# EasyEDA Pro project ProPrj_Avaota A1 八核 AIoT 开发板_2024-05-03.epro, board 点位_BOTTOM (continued)
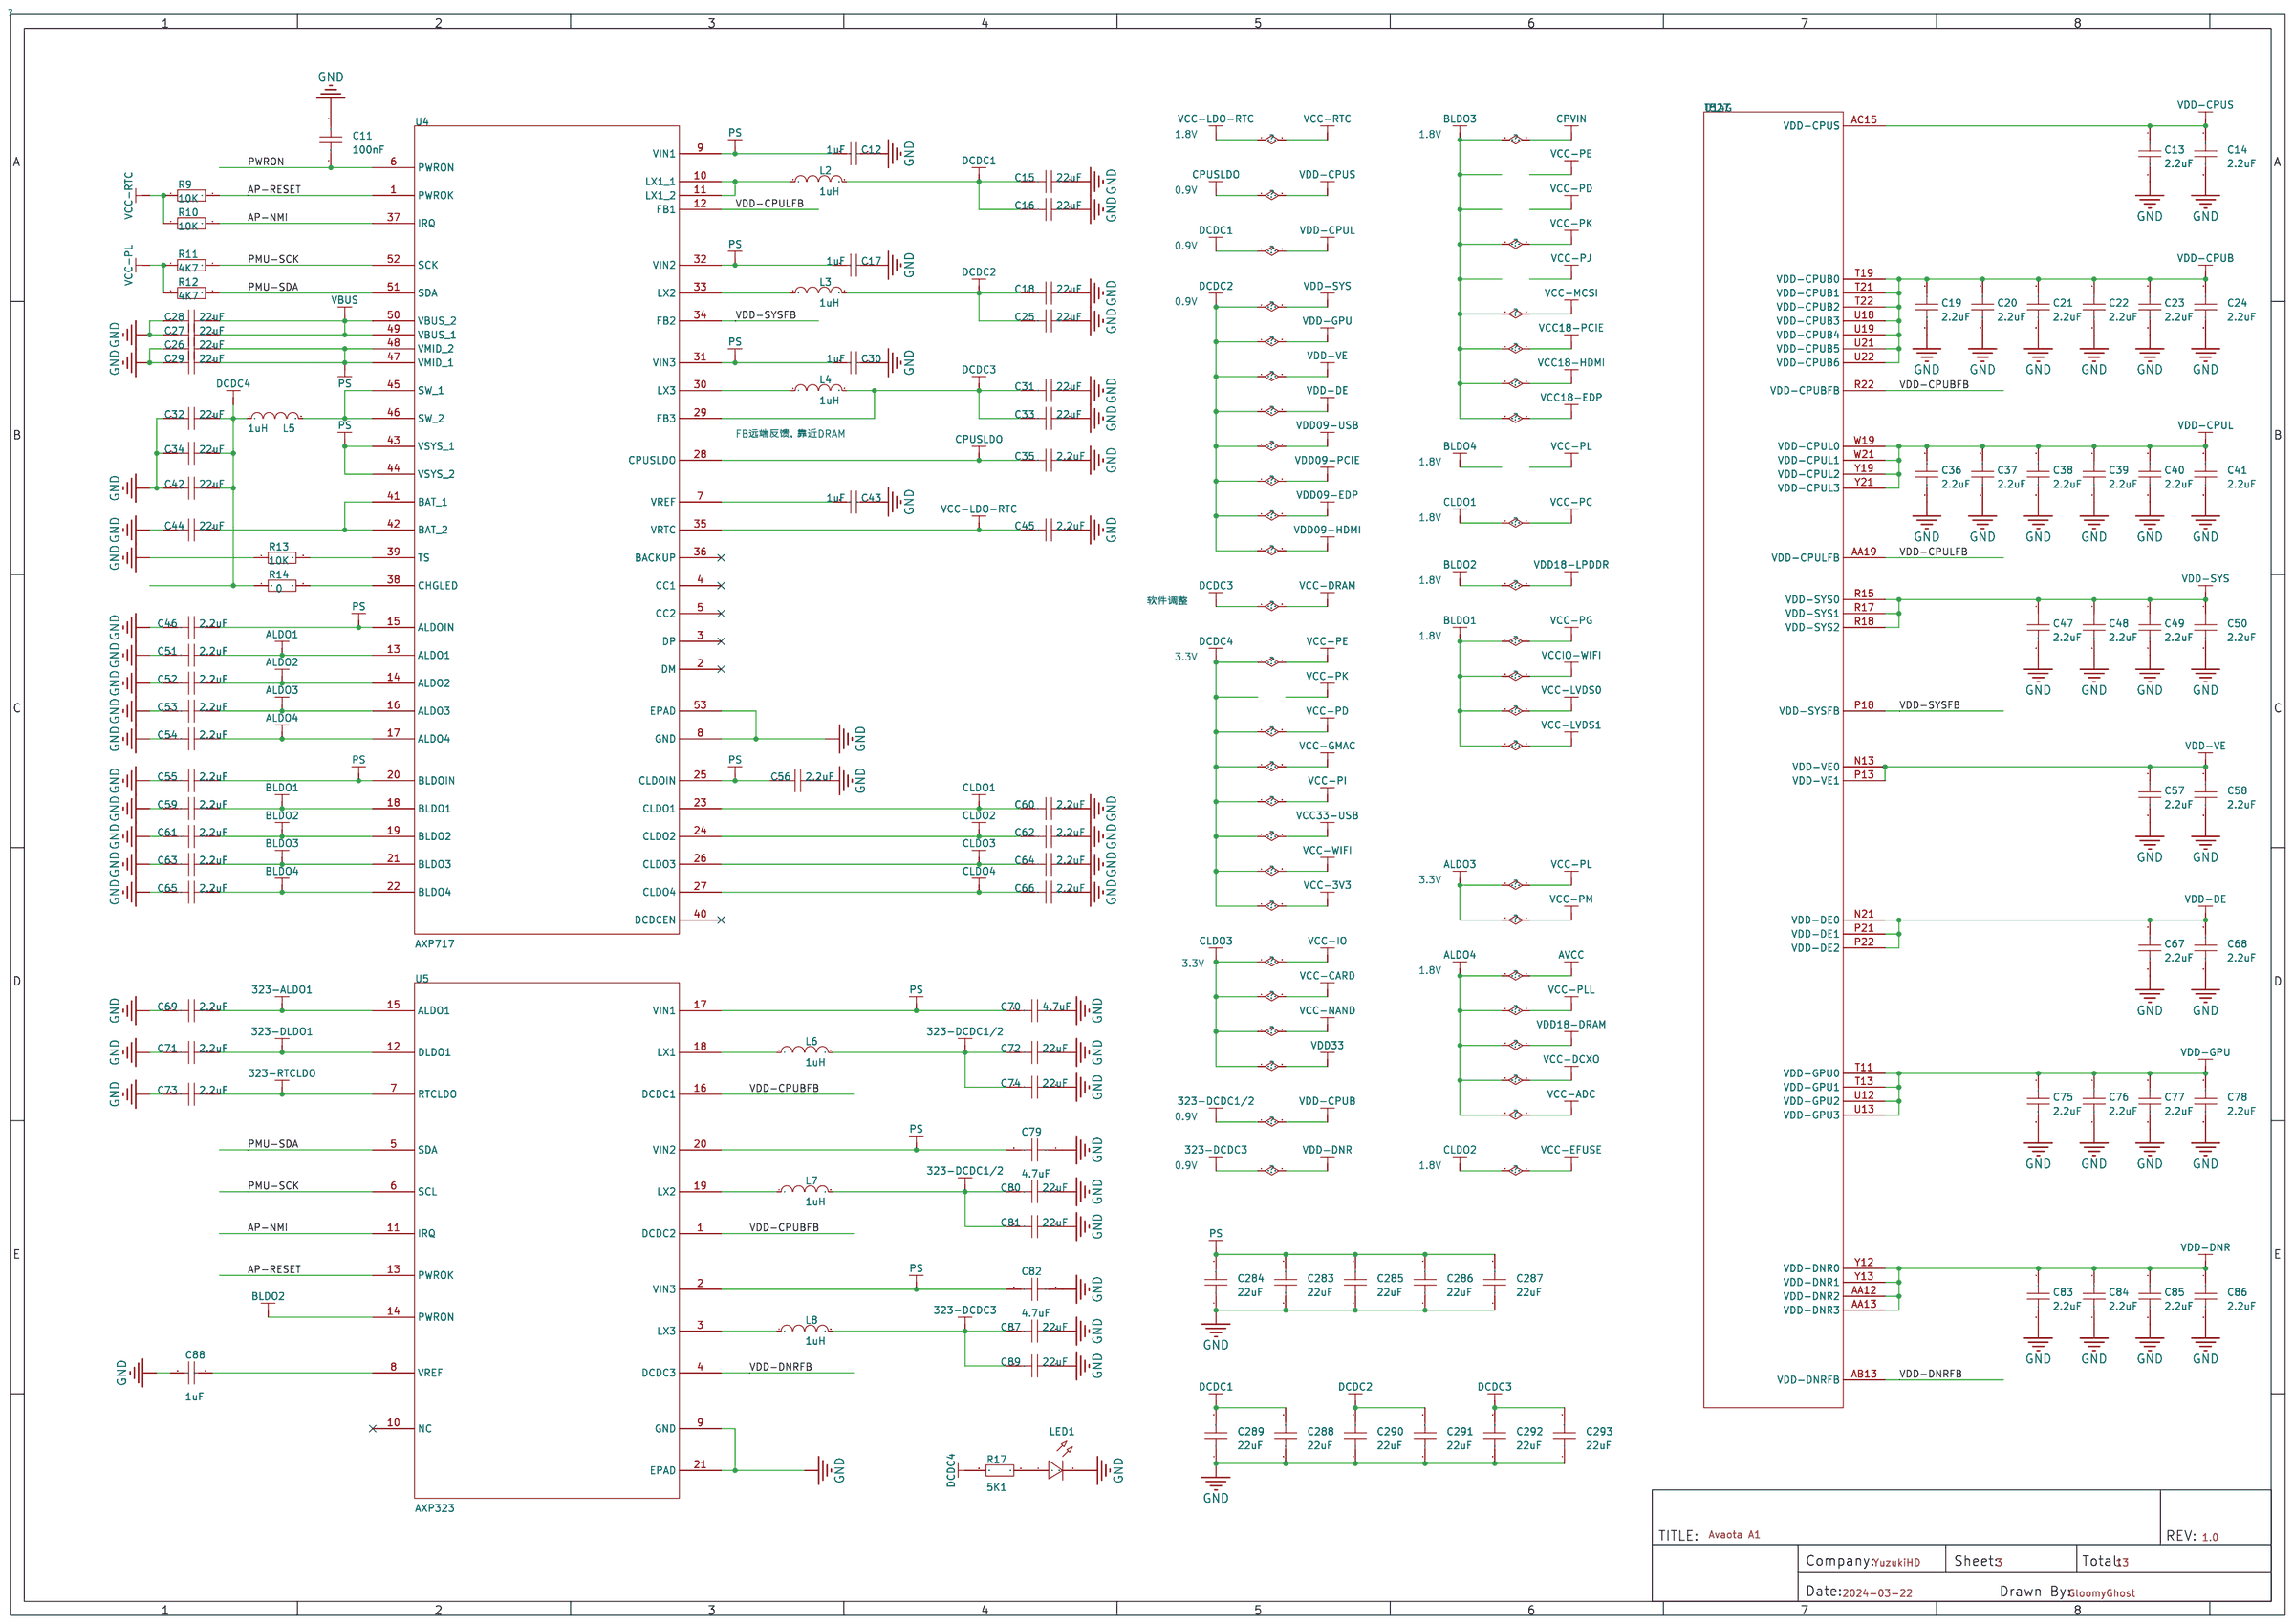
[diagram p0: POWER]
## Routing (per net, layer and track width the routed paths; a pad name or vN(x,y) marks a point on that pad's centre or on a via; arc(x,y) is an arc through that point) (continued)
EDP-HPD: length 36.9
  内层2 w0.127: v2(67.93,42.15) 69.61,42.15 70.51,41.25 70.51,38.35 66.85,34.7 66.85,33.4 66.32,32.87 57.73,32.87 v2(51.1,26.24)
  Bottom Layer w0.127: v2(50.64,22.2) 50.5,22.06 50.5,19.46 50.9,19.05 51.1,19.05 51.56,18.59 51.56,17.93 52.06,17.43 52.39,17.43
EDP-TX0N: length 23.4
  内层2 w0.127: v2(75.52,32.71) 75.39,32.71 75.11,32.99 74.73,32.99 74.29,32.56 74.29,31.31 72.65,29.67 59.47,29.67 56.48,26.68 56.48,26.21 56.34,26.07 v2(56.34,25.83)
EDP-TX0P: length 22.9
  内层2 w0.127: v2(75.1,32.34) 75.16,32.39 75.16,32.61 75.03,32.74 74.83,32.74 74.55,32.46 74.55,31.24 72.75,29.44 59.56,29.44 56.71,26.58 56.71,26.21 56.87,26.05 v2(56.87,25.83)
EDP-TX1N: length 26.6
  内层2 w0.127: v2(54.81,25.86) 54.81,26.07 54.98,26.24 54.98,26.5 59.01,30.53 67.84,30.53 69.14,31.83 69.14,33.66 71.86,36.37 74.01,36.37 75.05,35.33 v2(75.29,35.33)
EDP-TX1P: length 26.1
  内层2 w0.127: v2(74.96,34.95) 74.96,35.1 73.91,36.14 71.95,36.14 69.37,33.56 69.37,31.7 67.97,30.3 59.11,30.3 55.21,26.41 55.21,26.24 55.37,26.08 v2(55.37,25.83)
EDP-TX2N: length 25.7
  内层2 w0.127: v1(73.13,37.52) 73,37.39 72.64,37.39 72.44,37.19 71.61,37.19 68.33,33.9 68.33,32.33 67.41,31.42 58.53,31.42 53.63,26.52 53.63,26.26 53.49,26.12 v2(53.49,25.86)
EDP-TX2P: length 25.7
  内层2 w0.127: v2(54,25.86) 54,26.12 53.86,26.26 53.86,26.43 58.62,31.19 67.51,31.19 68.55,32.23 68.55,33.81 71.7,36.96 72.59,36.96 72.77,37.14 v1(73.53,37.14)
EDP-TX3N: length 26.7
  内层2 w0.127: v2(51.99,25.81) 51.99,26.07 52.15,26.22 52.15,26.38 52.28,26.52 52.28,26.7 52.46,26.88 52.64,26.88 52.82,27.06 52.82,27.24 53,27.42 53.18,27.42 53.36,27.6 53.36,27.78 53.54,27.95 53.72,27.95 53.9,28.13 53.9,28.31 54.08,28.49 54.26,28.49 58.1,32.33 66.93,32.33 67.49,32.89 67.49,34.21 71.53,38.25 71.83,38.25 v1(72.03,38.46)
EDP-TX3P: length 26.3
  内层2 w0.127: v1(72.47,38.2) 72.29,38.02 71.63,38.02 67.72,34.11 67.72,32.79 67.03,32.11 58.19,32.11 52.38,26.29 52.38,26.22 52.53,26.07 v2(52.53,25.81)
EMMC-VDDI: length 1.8
  Bottom Layer w0.254: v2(42.24,36.5) 42.47,36.73 C232.2 ; C232.2 C231.1 ; C232.2 C233.2
FEL: length 71.4
  内层2 w0.152: v1(22.78,50.39) 19.61,53.57 19.61,58.7 v1(19.08,59.23)
  VCC w0.152: v2(66.94,49.15) 66.67,49.15 65.48,50.34 65.48,51.92 64.41,52.98 64.41,55.09 63.6,55.91 61.7,55.91 60.22,57.38 60.22,60.22 59.64,60.81 58.72,60.81 58.42,60.5 49.89,60.5 47.45,62.94 30.63,62.94 24.77,57.07 22.35,57.07 20.19,59.23 v1(19.08,59.23)
GM0_DVDD10: length 20.1
  Bottom Layer w0.584: 65.58,19.94 66.84,19.94 v2(67.6,19.18) ; 65.58,19.94 v2(65.58,19.15) ; 65.58,19.94 64.11,21.41 64.11,21.67 ; 64.11,21.67 64.11,23.85 61.87,26.09 v2(61.87,26.39) v2(61.87,26.95) ; 64.11,21.67 63.64,21.21 v2(62.86,21.21) ; 64.16,23.95 65.1,24.89 68.22,24.89 69.8,26.47 v2(69.8,26.73)
GM0_LED1: length 20.7
  内层4 w0.152: v1(57.99,6.2) 57.48,6.7 57.48,19.3 61.14,22.96 62.38,22.96 62.84,23.42 v1(62.84,23.72)
GM0_LED2: length 20.2
  内层4 w0.152: v1(62.31,23.42) 62.15,23.27 60.91,23.27 57.12,19.48 57.12,6.47 v1(57.4,6.19)
GM1_DVDD10: length 18.7
  Bottom Layer w0.254: v2(86.69,25.5) arc(86.25,25.08) 85.8,24.66
  Bottom Layer w0.635: 82.45,20.45 81.79,20.45 v2(81.31,20.93) ; 82.45,20.45 82.45,23.76 ; 82.45,20.45 82.8,20.09 ; v2(85.78,19.11) 84.8,20.09 82.8,20.09 ; 82.45,23.76 83.35,24.66 85.8,24.66 ; 82.45,23.76 v2(80.06,26.15) v2(80.06,26.62) ; 82.8,20.09 v2(83.77,19.13)
GM1_DVDDRG: length 403.4
  内层2 w0.33: v1(64.44,49.1) 64.95,48.59 v1(64.95,46.66) 64.8,46.66 63.32,45.19 61.14,45.19 60.71,45.62 59.46,45.62 58.93,46.15 58.93,48.36 58.64,48.65 v1(57.44,48.65)
  VCC w0.152: 3.25,56.79 4.7,56.79 v2(4.78,56.72)
  VCC w0.254: v1(50.19,26.19) 50.19,23.45 50.18,23.44 ; v1(65.63,26.71) 65.63,25.99 65.63,25.98 ; 64.03,20.75 64.47,20.32 70.1,20.32 v1(70.21,20.42) ; v2(88.49,20.27) 90.02,20.27 90.27,20.02 92.66,17.63 v2(94.06,17.63)
  VCC w0.381: v2(62.94,52.58) 62.94,52.2 63.09,52.04 64.24,52.04 v1(64.39,52.2) 64.95,51.64 v1(64.95,46.66) 64.95,44.15 v2(64.44,43.65) 64.44,43.64 64.44,41.45 64.67,41.22 ; v1(65.46,46.66) 65.43,46.63 65.43,41.53 65.02,41.12
  VCC w0.508: 81.52,23.98 81.52,23.99 v2(83.25,25.72) 83.63,25.72 v2(83.76,25.84) 83.69,25.91 83.69,26.97 83.87,27.15 v1(83.87,27.86) ; v1(16.84,57.83) 15.88,58.79 15.88,67.84 15.01,68.71 ; 52.73,23.44 52.83,23.34 52.83,19.17 52.39,18.73
  VCC w0.762: v1(91.08,38.68) v1(91.41,38.36) 92.53,37.24 92.53,21.79 90.75,20.02 90.27,20.02 87.71,20.09 ; 70.76,27.39 70.47,27.69 v1(69,27.69) v1(67.34,27.69) ; 70.76,27.39 70.76,28.55 65.73,33.59 65.73,40.12 64.74,41.1 ; 70.76,27.39 70.76,26.59 70.38,26.21 ; v2(60.02,24.56) 62.63,24.56 62.69,24.62 ; 62.69,24.62 64.05,25.98 v2(65.13,25.98) 76.66,25.98 78.59,24.05 v2(78.59,23.98) 81.67,23.98 82.32,23.32 82.32,20.68 ; 62.69,24.62 63.03,24.62 64.03,23.62 64.03,20.75 v1(63.37,20.09) ; 87.71,20.09 82.91,20.09 82.32,20.68 ; 87.71,20.09 88.5,20.09 ; 82.32,20.68 v2(80.82,19.18)
  VCC w1.27: 3.25,53.14 3.25,66.04 5.82,68.61 ; 5.82,68.61 7.9,70.69 ; 5.82,68.61 26.14,68.61 28.22,70.69 ; v2(60.02,24.56) 58.9,23.44 48.74,23.44 46.38,25.81 40.11,25.81 38.53,24.23 32.58,24.23 26.43,18.09 6.07,18.09 1.57,22.58 1.57,51.13 3.46,53.01 v2(3.56,53.01)
  Bottom Layer w0.254: C170.2 64.44,52.25 v1(64.39,52.2) ; v1(89.99,44.93) 90.07,44.93 90.45,45.31 90.45,48.11 88.72,49.84 U16.5 89.19,50.53 C276.1 ; 65.31,46.89 65.46,46.75 v1(65.46,46.66) C176.2 ; C167.2 64.93,46.68 v1(64.95,46.66) 64.92,46.63 C175.2 ; C224.2 52.4,21.05 52.73,20.73 ; v1(92.74,29.85) 93.34,29.85 ; 93.34,29.85 93.46,29.96 FPC2.4 ; 93.34,29.85 92.96,29.46 ; FPC1.3 5.51,36.78 2.05,36.78 v1(1.96,36.88) ; 92.05,1.48 90.84,2.69 ; 90.84,2.69 91.54,2.69 95.35,6.5 95.35,16.33 95.02,16.66 ; 90.84,2.69 80.05,2.69 78.84,1.48 78.55,1.78 74.06,1.78 73.79,1.5 72.29,3 62.07,3 60.58,1.5 ; FPC2.2 92.91,28.96 92.68,29.18 92.96,29.46 ; 52.73,20.73 53.19,21.19 C223.2 ; 52.73,20.73 52.73,19.07 52.39,18.73 ; FPC2.3 92.96,29.46 ; v1(1.93,36.32) 1.98,36.28 FPC1.4 ; U11.5 C204.2 98.59,16.93 98.32,16.66 95.02,16.66 ; v2(64.44,43.65) 64.44,43.21 C169.2 ; 95.02,16.66 v2(94.06,17.63) ; C174.2 C173.2 64.39,49.15 v1(64.44,49.1)
  Bottom Layer w0.33: C178.2 57.39,48.64 C177.2
  Bottom Layer w0.381: v2(89.74,21.97) 89.89,22.12 89.89,23.34 89.41,23.83 88.01,23.83 87.27,24.56 87.27,25.78 86.94,26.11 86.28,26.11 86,25.83 83.77,25.83 v2(83.76,25.84)
  Bottom Layer w0.635: 71.91,21.9 69.77,21.9 69.16,22.5 69.16,24.74 70.56,26.14 70.56,27.05 69.93,27.69 ; v1(69,27.69) 69.02,27.71 69.82,27.71
  vias: v1(92.74,29.24) v2(3.56,53.54) v2(4.09,53.54) v2(4.11,53.04) v2(4.6,53.52) v2(71.96,21.9)
GM1_LED1: length 22.1
  内层2 w0.152: v1(81.41,23.29) 81.41,22.99 80.95,22.53 80.77,22.53 76.71,18.47 76.71,12.24 75.72,11.25 74.32,11.25 73.43,10.36 73.43,8.99 74.68,7.75 75.95,7.75 v2(76.3,8.1)
GM1_LED2: length 21.3
  内层2 w0.152: v2(75.64,7.31) 75.54,7.42 74.52,7.42 73.15,8.79 73.15,10.54 74.24,11.63 75.56,11.63 76.35,12.42 76.35,18.57 v1(80.82,23.04)
HBIAS: length 29
  内层2 w0.254: v2(63.96,69.55) 65.06,68.44 v2(71.78,68.44)
  GND2 w0.254: v2(63.96,69.55) 63.96,68.89 62.38,67.31 56.41,67.31 54.86,65.76 54.86,57.56 v2(54.71,57.4)
  Bottom Layer w0.127: v2(71.78,68.44) C237.2 71.04,68.59 R64.2
HCEC: length 45.9
  Inner5 w0.127: v2(67.44,43.15) 67.82,42.77 69.42,42.77 69.8,42.39 70.28,42.39 70.54,42.14 70.54,36.4 68.12,33.99 68.12,32.33 64.59,28.8 60.27,28.8 59.31,27.84 47.45,27.84 44.4,24.79 43.97,24.79 43.64,24.46 42.54,24.46 42.11,24.03 41.28,24.03 v2(40.36,23.11)
HHPD: length 42
  Inner5 w0.127: v2(67.94,43.15) 69.55,43.15 69.93,42.77 70.43,42.77 70.92,42.29 70.92,36.17 68.5,33.76 68.5,32.06 64.85,28.4 60.48,28.4 59.51,27.43 47.7,27.43 44.6,24.33 v2(44.3,24.33)
HP-DET: length 22.3
  GND2 w0.152: v2(66.73,71.07) 62.61,66.95 56.67,66.95 55.27,65.56 55.27,57.25 v2(55.07,57.05)
HPOUTFB: length 21
  GND2 w0.254: v2(53.59,57.61) 54,58.01 54,66.37 55.91,68.28 61.62,68.28 v2(62.64,69.29)
  Bottom Layer w0.254: C239.1 70.45,70.71 70.1,70.71 v2(69.89,70.5) R66.2 R122.2
HPOUTL: length 20
  GND2 w0.254: v2(63.35,69.04) 62.15,67.84 56.21,67.84 54.43,66.07 54.43,57.81 v2(54.2,57.58)
  Bottom Layer w0.254: v2(68.76,70.59) 68.76,70.16 C243.1
HPOUTR: length 20.7
  GND2 w0.254: v2(53.04,57.43) 53.04,57.73 53.57,58.27 53.57,66.68 55.65,68.76 61.37,68.76 v2(61.67,69.06)
  Bottom Layer w0.254: v2(68.91,66.9) 68.91,67.91 68.14,68.68
HREXT: length 0.5
  Bottom Layer w0.254: R59.2 66.91,44.12 v2(66.94,44.15)
HS-MIC: length 6
  Bottom Layer w0.127: 70.49,69.57 70.48,69.58
  Bottom Layer w0.254: v2(74.5,72.19) 72.85,70.54 71.58,70.54 71.16,70.12 71.04,70.12 R64.1 ; 70.48,70.12 R65.2 ; 70.49,69.57 71.04,69.57
HSCL: length 47.4
  Inner5 w0.127: v2(67.94,44.15) 68.09,44.15 68.48,43.76 70.41,43.76 71.22,42.95 71.22,35.97 68.86,33.6 68.86,31.9 64.97,28.02 60.68,28.02 59.74,27.08 47.93,27.08 44.81,23.95 42.72,23.95 42.34,23.57 41.38,23.57 v2(40.92,23.11)
HSDA: length 48
  Inner5 w0.127: v2(42.01,23.17) 42.82,23.17 43.26,23.6 44.91,23.6 48.01,26.7 59.92,26.7 60.88,27.66 65.23,27.66 69.24,31.67 69.24,33.43 71.55,35.74 71.55,43.13 70.53,44.15 68.5,44.15 68.1,44.55 67.84,44.55 v2(67.44,44.15)
HTX0N: length 53
  内层4 w0.102: v2(74.52,41.43) 74.7,41.61 76.33,41.61 77.5,40.44 77.5,30.25 75.56,28.31 71.48,28.31 69.62,30.18 60.22,30.18 58.73,28.68 48.15,28.68 46.43,26.96 46.43,24.08 45.19,22.83 45.19,22.58 45.03,22.43 v2(45.03,22.17)
HTX0P: length 53.4
  内层4 w0.102: v2(45.54,22.17) 45.54,22.43 45.39,22.58 45.39,22.79 46.61,24.01 46.61,26.85 48.23,28.47 58.81,28.47 60.31,29.97 69.49,29.97 71.36,28.11 75.64,28.11 77.7,30.17 77.7,40.52 76.41,41.81 74.65,41.81 v2(74.52,41.94)
HTX1N: length 54.4
  内层4 w0.102: v2(74.93,42.34) 75.11,42.52 76.73,42.52 78.36,40.89 78.36,29.87 76,27.51 71.09,27.51 69.32,29.29 60.6,29.29 59.18,27.86 48.66,27.86 47.37,26.58 47.37,26.08 47.24,25.95 47.24,25.7 47.37,25.57 47.37,25.32 47.24,25.19 47.24,24.93 47.37,24.81 47.37,24.55 47.24,24.43 47.24,24.17 47.37,24.05 47.37,23.46 47.13,23.22 46.99,23.22 46.97,23.23 46.83,23.23 46.7,23.11 46.7,22.96 46.72,22.95 46.72,22.8 46.6,22.68 46.6,22.54 46.46,22.4 v2(46.46,22.15)
HTX1P: length 54.2
  内层4 w0.102: v2(74.9,42.88) 75.03,42.75 76.84,42.75 78.54,41.05 78.54,29.76 76.08,27.3 70.99,27.3 69.22,29.08 60.69,29.08 59.27,27.66 48.74,27.66 47.57,26.49 47.57,23.36 46.8,22.59 46.8,22.54 46.96,22.37 v2(46.96,22.15)
HTX2N: length 54.6
  内层4 w0.102: v2(75.34,43.41) 75.49,43.56 77.07,43.56 79.17,41.46 79.17,29.39 76.56,26.77 70.77,26.77 69.2,28.35 60.8,28.35 59.63,27.18 49.09,27.18 48.12,26.2 48.12,22.56 47.96,22.4 v2(47.96,22.15)
HTX2P: length 55
  内层4 w0.102: v2(75.34,43.92) 75.49,43.76 77.11,43.76 79.38,41.5 79.38,29.3 76.64,26.57 70.69,26.57 69.11,28.14 60.88,28.14 59.72,26.98 49.17,26.98 48.32,26.12 48.32,22.56 48.48,22.4 v2(48.48,22.15)
HTXCN: length 51.2
  内层4 w0.102: v2(43.59,22.17) 43.59,22.43 43.75,22.59 43.75,22.73 43.85,22.82 arc(43.9,22.94) 43.85,23.05 arc(43.8,23.16) 43.85,23.28 43.89,23.32 arc(44.01,23.37) 44.12,23.32 arc(44.23,23.27) 44.34,23.32 45.54,24.52 45.54,27.54 47.49,29.49 57.99,29.49 59.56,31.06 69.98,31.06 71.78,29.26 75.03,29.26 76.68,30.91 76.68,39.73 75.95,40.46 75.39,40.46 v2(75.21,40.28)
HTXCP: length 51.2
  内层4 w0.102: v2(75.21,40.84) 75.39,40.67 76.03,40.67 76.89,39.81 76.89,30.83 75.12,29.06 71.65,29.06 69.85,30.86 59.65,30.86 58.07,29.29 47.57,29.29 45.72,27.43 45.72,24.41 43.95,22.64 43.95,22.59 44.12,22.43 v2(44.12,22.17)
IR-RX: length 124
  内层2 w0.102: v1(54.94,48.67) 54.79,48.82 54.07,48.82 51.49,51.4 51.49,54.33 49.68,56.13 46.84,56.13 45.82,57.15 45.36,57.15 v1(44.81,57.71)
  内层4 w0.152: v1(43.59,64.87) 45.19,66.47 52.6,66.47 57.73,61.34 61.14,61.34 62.53,59.94 86.28,59.94 89.13,57.1 89.13,53.54 87.63,52.04 87.63,33.33 94.69,26.26 95.96,26.26 99.06,23.17 99.06,19.18 97.97,18.09 96.06,18.09 v1(94.08,16.1)
  Bottom Layer w0.102: v1(44.81,57.71) 45.21,58.12 45.21,58.85 44.04,60.02 44.04,63.78 43.84,63.98 43.84,64.62 v1(43.59,64.87)
LCD0-CLK: length 24.7
  Bottom Layer w0.127: v2(27.3,23.75) 25.93,23.75 22.73,20.55 21.59,20.55 20.35,19.3 9.75,19.3 7.23,16.78 FPC1.43
LCD0-D0: length 69.5
  内层2 w0.127: v2(63.95,42.65) 63.58,42.27 63.58,41.45 63.75,41.28 64.41,41.28 65.05,40.64 65.05,37.29 62.48,34.72 56.49,34.72 53.64,31.88 37.59,31.88 v2(34.82,34.65)
  Bottom Layer w0.127: v2(34.82,34.65) 34.64,34.83 5.56,34.83 FPC1.7
LCD0-D1: length 69.3
  内层2 w0.127: v2(63.95,42.15) 64.05,42.15 65.43,40.77 65.43,37.16 62.61,34.34 56.77,34.34 53.92,31.5 37.39,31.5 v2(34.82,34.06)
  Bottom Layer w0.127: v2(34.82,34.06) 34.39,34.49 11.74,34.49 11.52,34.28 FPC1.8
LCD0-D2: length 67.8
  内层2 w0.127: v2(34.85,33.43) 37.19,31.09 54.15,31.09 57,33.93 64.01,33.93 68.2,38.13 v2(68.76,38.13)
  Bottom Layer w0.127: v2(34.85,33.43) 34.16,34.11 14.05,34.11 13.46,33.53 11.66,33.53 11.41,33.78 FPC1.9
LCD0-D3: length 68
  内层2 w0.127: v2(68.4,37.72) 64.24,33.55 57.18,33.55 54.23,30.61 37.06,30.61 v2(34.85,32.82)
  Bottom Layer w0.127: v2(34.85,32.82) 33.93,33.73 14.45,33.73 14.15,33.43 14.15,33.4 13.23,32.49 11.96,32.49 11.17,33.28 FPC1.10
LCD0-D4: length 70.2
  Bottom Layer w0.127: v2(67.92,41.65) 67.72,41.65 67.56,41.49 67.56,40.91 67.32,40.67 64.9,40.67 64.59,40.97 62.43,40.97 61.01,39.55 61.01,37.72 57.23,33.93 45.24,33.93 42.39,31.09 35.89,31.09 33.66,33.33 14.86,33.33 13.59,32.06 11.58,32.06 10.86,32.78 FPC1.11
LCD0-D5: length 70.1
  Bottom Layer w0.127: v2(67.92,41.15) 67.92,40.75 67.46,40.28 64.77,40.28 64.47,40.59 62.66,40.59 61.49,39.42 61.49,37.59 57.38,33.48 45.44,33.48 42.6,30.63 35.69,30.63 33.38,32.94 15.09,32.94 13.77,31.62 11.38,31.62 10.73,32.28 FPC1.12
LCD0-D6: length 69.8
  Bottom Layer w0.127: FPC1.13 10.49,31.78 11.02,31.24 14.07,31.24 15.37,32.54 33.12,32.54 35.48,30.18 42.85,30.18 45.72,33.05 57.56,33.05 61.9,37.39 61.9,39.22 62.89,40.21 64.34,40.21 64.62,39.93 67.28,39.93 v2(67.94,39.27)
LCD0-D7: length 69.4
  Bottom Layer w0.127: FPC1.14 10.35,31.28 10.79,30.84 14.33,30.84 15.6,32.11 32.94,32.11 35.31,29.74 43.03,29.74 45.92,32.64 57.78,32.64 62.36,37.21 62.36,39.14 63.02,39.8 64.11,39.8 64.31,39.6 66.9,39.6 v2(67.54,38.96)
LCD0-D8: length 65.3
  Bottom Layer w0.127: FPC1.15 10.22,30.78 10.54,30.45 14.6,30.45 15.82,31.67 32.84,31.67 35.15,29.36 43.21,29.36 46.1,32.26 58.01,32.26 62.79,37.03 62.79,39.01 63.2,39.42 v2(63.91,39.42)
LCD0-D9: length 64.8
  Bottom Layer w0.127: FPC1.16 10.06,30.28 10.29,30.05 14.81,30.05 15.98,31.22 32.79,31.22 34.98,29.03 43.43,29.03 46.28,31.88 55.96,31.88 56.01,31.93 58.22,31.93 63.14,36.86 63.14,37.36 63.68,37.9 63.68,38.86 v2(63.55,38.99)
LCD0-D10: length 60.1
  Inner5 w0.127: v2(32.31,30.81) 43.36,30.81 45.9,33.35 61.98,33.35 63.17,34.54 v2(63.47,34.54)
  Bottom Layer w0.127: v2(32.31,30.81) 32.28,30.84 16.18,30.84 14.99,29.64 10.11,29.64 9.97,29.78 FPC1.17
LCD0-D11: length 61
  Inner5 w0.127: v2(63.93,34.93) 63.93,34.49 62.36,32.92 46.1,32.92 43.59,30.4 v2(32.77,30.4)
  Bottom Layer w0.127: FPC1.18 15.21,29.28 16.33,30.4 v2(32.77,30.4)
LCD0-D12: length 70.2
  Inner5 w0.127: v2(66.92,41.65) 66.77,41.65 66.55,41.43 66.55,40.92 66.7,40.77 66.7,38.74 66.27,38.3 65.76,38.3 65.28,37.82 65.28,36.42 65.51,36.2 65.51,35.56 62.41,32.46 46.3,32.46 43.84,30 v2(33.17,30)
  Bottom Layer w0.127: FPC1.19 15.34,28.78 16.56,30 v2(33.17,30)
LCD0-D13: length 70.1
  Inner5 w0.127: v2(33.55,29.57) 44.07,29.57 46.56,32.06 62.64,32.06 65.84,35.26 65.84,36.4 65.61,36.63 65.61,37.47 65.99,37.85 66.37,37.85 67.03,38.51 67.03,41.04 v2(66.92,41.15)
  Bottom Layer w0.127: v2(33.55,29.57) 16.76,29.57 15.48,28.28 FPC1.20
LCD0-D14: length 67
  Inner5 w0.127: v2(34.01,29.16) 44.3,29.16 46.76,31.62 62.86,31.62 66.12,34.87 66.12,36.63 65.94,36.8 65.94,37.19 66.22,37.47 66.7,37.47 v2(66.83,37.34)
  Bottom Layer w0.127: v2(34.01,29.16) 17.04,29.16 15.66,27.78 FPC1.21
LCD0-D15: length 66.4
  Inner5 w0.127: v2(34.32,28.7) 44.42,28.7 46.91,31.19 63.12,31.19 66.4,34.47 v2(66.4,36.98)
  Bottom Layer w0.127: v2(34.32,28.7) 17.25,28.7 15.82,27.28 FPC1.22
LCD0-D16: length 64
  内层4 w0.127: v2(28.88,28.22) 35.31,28.22 39.85,32.77 56.39,32.77 57.07,33.45 60.17,33.45 62,35.28 62,36.53 62.69,37.21 63.17,37.21 63.27,37.31 v2(63.27,38.51)
  Bottom Layer w0.127: v2(28.88,28.22) 17.37,28.22 15.93,26.78 FPC1.23
LCD0-D17: length 86
  内层4 w0.127: v2(29.26,27.81) 35.46,27.81 40.06,32.41 56.51,32.41 57.2,33.1 60.35,33.1 62.36,35.1 62.36,36.27 62.97,36.88 v2(63.58,36.88)
  Inner5 w0.127: 42.39,32.87 45.06,35.53 60.83,35.53 62.18,36.88 v2(63.58,36.88)
  Bottom Layer w0.127: FPC1.24 16.12,26.28 17.65,27.81 v2(29.26,27.81)
LCD0-D18: length 69
  内层4 w0.127: v2(65.94,41.63) 65.94,38.99 65.2,38.25 65.2,37.41 60.5,32.72 57.4,32.72 56.72,32.03 40.21,32.03 35.59,27.41 v2(29.59,27.41)
  Bottom Layer w0.127: v2(29.59,27.41) 17.93,27.41 16.3,25.78 FPC1.25
LCD0-D19: length 68.9
  内层4 w0.127: v2(66.85,35.51) 66.73,35.38 v2(64.36,35.38)
  Inner5 w0.127: v2(29.95,27) 33.53,27 34.85,28.32 44.78,28.32 47.19,30.73 63.35,30.73 66.85,34.24 v2(66.85,35.51)
  Bottom Layer w0.127: FPC1.26 16.49,25.28 18.19,26.98 29.92,26.98 v2(29.95,27)
LCD0-D20: length 76.3
  Inner5 w0.127: v2(30.33,26.52) 33.63,26.52 35.08,27.97 45.09,27.97 47.42,30.3 63.58,30.3 67.31,34.04 67.31,38.1 68.33,39.12 68.33,39.42 67.31,40.44 67.31,42.34 67.16,42.49 66.08,42.49 v2(65.95,42.63)
  Bottom Layer w0.127: v2(30.33,26.52) 18.47,26.52 16.73,24.78 FPC1.27
LCD0-D21: length 70.8
  内层4 w0.127: v2(30.73,26.09) 31.67,27.03 35.84,27.03 40.46,31.65 56.92,31.65 57.66,32.39 60.68,32.39 65.53,37.24 65.53,38.05 66.32,38.84 66.32,41.76 v2(65.95,42.13)
  Bottom Layer w0.127: v2(30.73,26.09) 18.72,26.09 16.91,24.28 FPC1.28
LCD0-D22: length 22.5
  Bottom Layer w0.127: v2(27.3,25.6) 19,25.6 17.17,23.78 FPC1.29
LCD0-D23: length 23
  Bottom Layer w0.127: FPC1.30 17.36,23.28 19.23,25.15 v2(27.71,25.15)
LCD0-DE: length 70.4
  Inner5 w0.127: v2(64.39,37.21) 64.39,36.5 61.67,33.78 45.75,33.78 43.15,31.19 29.03,31.19 26.49,28.65 26.49,23.14 25.27,21.92 v2(23.44,21.92)
  Bottom Layer w0.127: v2(23.44,21.92) 20.9,21.92 19.43,20.45 9.12,20.45 6.95,18.28 FPC1.40
LCD0-HSYNC: length 83.7
  Inner5 w0.127: v2(22.45,21.03) 23.27,21.03 23.77,21.54 25.6,21.54 26.87,22.81 26.87,25.83 27.18,26.14 29.97,26.14 30.48,25.63 30.99,25.63 31.45,26.09 33.86,26.09 35.33,27.56 45.31,27.56 47.62,29.87 63.81,29.87 67.67,33.73 67.67,37.85 68.63,38.81 68.63,39.7 67.57,40.76 67.57,42.46 67.28,42.75 66.47,42.75 66.19,43.03 65.33,43.03 v2(64.95,42.65)
  Bottom Layer w0.127: FPC1.42 7.14,17.28 9.58,19.71 20.04,19.71 21.36,21.03 v2(22.45,21.03)
LCD0-PWM: length 73.7
  内层2 w0.127: v2(64.24,37.77) 63.14,37.77 60.81,35.43 56.03,35.43 53.29,32.69 42.54,32.69 41.48,33.76 40.97,33.76 40.03,32.82 37.8,32.82 36.68,33.93 36.68,34.95 36.19,35.43 31.09,35.43 27.69,32.03 27.69,26.04 28.12,25.6 v2(28.12,24.66)
  Bottom Layer w0.127: v2(28.12,24.66) 19.41,24.66 17.58,22.83 7.19,22.83 6.63,22.28 FPC1.32
LCD0-RST: length 72.8
  内层2 w0.127: v2(28.5,24.23) 28.5,25.81 28.09,26.21 28.09,31.9 31.27,35.08 35.99,35.08 36.3,34.77 36.3,33.83 37.85,32.28 53.47,32.28 56.26,35.08 61.01,35.08 63.3,37.36 v2(63.88,37.36)
  Bottom Layer w0.127: FPC1.33 6.79,21.78 7.42,22.4 17.86,22.4 19.68,24.23 v2(28.5,24.23)
LCD0-VSYNC: length 80.3
  内层2 w0.127: v2(64.95,42.15) 64.61,42.15 64.36,42.39 64.36,42.73 64.07,43.03 63.7,43.03 63.32,42.65 63.32,39.4 62.86,38.94 62.86,38 60.66,35.79 55.8,35.79 53.19,33.17 42.65,33.17 41.71,34.11 40.77,34.11 40.23,33.58 39.19,33.58 38.81,33.96 38.81,34.47 38.46,34.82 37.47,34.82 36.5,35.79 30.81,35.79 27.23,32.21 27.23,26.42 26.77,25.96 26.77,24.05 25.5,22.78 24.87,22.78 23.55,21.46 v2(22.94,21.46)
  Bottom Layer w0.127: FPC1.41 7.01,17.78 9.32,20.09 19.76,20.09 21.13,21.46 v2(22.94,21.46)
LEDC: length 109.1
  内层2 w0.076: v1(81.18,48.59) 81.69,48.08 81.69,28.78 78.13,25.22 78.13,23.65 74.52,20.04 69.8,20.04 69.19,20.65 63.3,20.65 61.87,19.23 59.64,19.23 57.12,21.74 51.26,21.74 50.09,20.57 38.86,20.57 34.26,15.98 5.61,15.98 v1(2.62,18.97)
MCSI0-CKN: length 38.8
  Bottom Layer w0.102: FPC2.12 93.94,33.96 93.79,34.11 93.3,34.11 93.17,33.98 92.92,33.98 92.79,34.11 92.54,34.11 92.41,33.98 92.16,33.98 92.03,34.11 91.78,34.11 91.65,33.98 91.39,33.98 91.27,34.11 91.01,34.11 90.89,33.98 90.63,33.98 90.51,34.11 86.01,34.11 84.33,35.79 84.33,38.68 83.01,40.01 83.01,49.2 79.29,52.92 71.69,52.92 71.5,52.73 v1(71.5,52.45)
MCSI0-CKP: length 38.5
  Bottom Layer w0.102: FPC2.13 93.94,34.46 93.79,34.31 86.23,34.31 84.56,35.99 84.56,38.76 83.21,40.11 83.21,49.28 79.37,53.12 71.6,53.12 71.39,52.91 v1(71.07,52.91)
MCSI0-D0N: length 30.6
  Bottom Layer w0.102: v1(79.58,49.1) 79.58,48.82 80.11,48.29 80.11,39.22 82.12,37.21 82.12,33.55 84.55,31.12 90.65,31.12 90.77,30.99 91.03,30.99 91.15,31.12 91.41,31.12 91.53,30.99 91.79,30.99 91.92,31.12 92.17,31.12 92.3,30.99 92.55,30.99 92.68,31.12 92.93,31.12 93.06,30.99 93.31,30.99 93.44,31.12 93.85,31.12 93.95,31.01 94.54,31.01 FPC2.6
MCSI0-D0P: length 29.7
  Bottom Layer w0.102: v1(80.11,49.07) 80.11,48.64 80.34,48.41 80.34,39.27 82.32,37.29 82.32,33.63 84.66,31.29 93.88,31.29 94.05,31.46 FPC2.7
MCSI0-D1N: length 39.8
  Bottom Layer w0.102: FPC2.9 93.94,32.46 93.79,32.61 93.07,32.61 92.89,32.43 92.69,32.43 92.51,32.61 92.31,32.61 92.13,32.43 91.93,32.43 91.75,32.61 91.55,32.61 91.37,32.43 91.17,32.43 90.98,32.61 90.79,32.61 90.6,32.43 90.41,32.43 90.22,32.61 90.03,32.61 89.84,32.43 89.64,32.43 89.46,32.61 89.26,32.61 89.08,32.43 88.88,32.43 88.7,32.61 88.5,32.61 88.32,32.43 88.12,32.43 87.94,32.61 87.74,32.61 87.56,32.43 87.36,32.43 87.17,32.61 86.98,32.61 86.79,32.43 86.6,32.43 86.41,32.61 86.22,32.61 86.03,32.43 85.84,32.43 85.65,32.61 85,32.61 83.21,34.41 83.21,37.97 81.76,39.42 81.76,48.97 78.91,51.82 72.13,51.82 v1(72.09,51.87)
MCSI0-D1P: length 42.9
  Bottom Layer w0.102: FPC2.10 93.94,32.96 93.79,32.81 85.09,32.81 83.41,34.49 83.41,38.05 81.97,39.5 81.97,49.12 79.06,52.03 72.46,52.03 72.28,52.21 71.87,52.21 70.79,51.13 v1(68,51.13)
MCSI0-D2N: length 40.1
  Inner5 w0.102: v2(66.93,51.13) 67.51,50.55 80.35,50.55 83.34,47.57 83.34,37.61 85.34,35.61 89.72,35.61 89.87,35.46 v1(90.12,35.46)
  Bottom Layer w0.102: v1(90.12,35.46) 90.27,35.61 93.79,35.61 93.94,35.46 FPC2.15
MCSI0-D2P: length 40.1
  Inner5 w0.102: v1(90.12,35.97) 89.87,35.97 89.72,35.81 85.42,35.81 83.54,37.69 83.54,47.65 80.43,50.76 71.85,50.76 71.72,50.89 71.47,50.89 71.34,50.76 71.09,50.76 70.96,50.89 70.7,50.89 70.58,50.76 70.32,50.76 70.2,50.89 69.94,50.89 69.82,50.76 69.56,50.76 69.44,50.89 69.18,50.89 69.05,50.76 68.8,50.76 68.67,50.89 68.42,50.89 68.29,50.76 67.63,50.76 67.46,50.93 v2(67.46,51.13)
  Bottom Layer w0.102: FPC2.16 93.94,35.96 93.79,35.81 90.27,35.81 v1(90.12,35.97)
MCSI0-D3N: length 40.6
  Inner5 w0.102: v2(67.44,52.15) 67.61,51.97 67.61,51.77 67.85,51.53 68.57,51.53 70.43,53.39 72.64,53.39 74.12,51.92 80.98,51.92 84.71,48.18 84.71,38.47 86.09,37.09 93.05,37.09 93.21,36.93 v1(93.47,36.93)
  Bottom Layer w0.102: 94.34,37.09 93.88,37.09 93.72,36.93 v1(93.47,36.93)
MCSI0-D3P: length 40.6
  Inner5 w0.102: v2(67.94,52.15) 67.79,51.99 67.79,51.84 67.93,51.71 68.46,51.71 68.53,51.77 68.53,51.97 68.7,52.14 68.9,52.14 69.07,52.31 69.07,52.51 69.24,52.68 69.44,52.68 70.35,53.59 72.73,53.59 74.18,52.15 81.03,52.15 84.91,48.27 84.91,38.56 86.17,37.3 93.05,37.3 93.21,37.46 v1(93.46,37.46)
  Bottom Layer w0.102: v1(93.46,37.46) 93.72,37.46 93.88,37.3 94.34,37.3
MCSI0-MCLK: length 36
  Bottom Layer w0.152: v1(69.62,53.44) 70.03,53.85 79.86,53.85 84.1,49.61 84.1,40.82 84.88,40.03 94.52,40.03 FPC2.24
MCSI0-PWDN: length 31.4
  Bottom Layer w0.102: FPC2.28 94.11,41.96 93.88,41.73 86.21,41.73 85.47,42.47 85.47,49.91 80.19,55.19 77.57,55.19 77.19,55.58 75.72,55.58 75.23,55.09 75.23,54.74 75.49,54.48 75.9,54.48 v1(76.28,54.86)
MCSI0-RSTN: length 29.2
  Bottom Layer w0.102: FPC2.27 86.05,41.46 85.19,42.32 85.19,49.78 80.11,54.86 77.44,54.86 77.01,55.3 76.12,55.3 v1(75.69,54.86)
MCSI0-SCK: length 39.2
  Inner5 w0.102: v1(93.12,38.66) 93.09,38.66 91.95,39.8 89.61,39.8 85.88,43.54 85.88,48.69 81.61,52.96 74.9,52.96 73.41,54.46 69.95,54.46 68.22,52.73 67.69,52.73 67.44,52.98 v2(67.44,53.13)
  Bottom Layer w0.102: FPC2.21 93.31,38.46 v1(93.12,38.66)
  Bottom Layer w0.152: R127.2 68.49,53.49 67.67,53.49 67.44,53.27 v2(67.44,53.13)
MCSI0-SDA: length 37.7
  Inner5 w0.102: v1(93.14,39.24) 92.96,39.24 92.15,40.06 89.79,40.06 86.16,43.69 86.16,48.84 81.74,53.26 75.08,53.26 73.61,54.74 69.8,54.74 68.19,53.13 v2(67.94,53.13)
  Bottom Layer w0.102: FPC2.22 93.42,38.96 v1(93.14,39.24)
  Bottom Layer w0.152: R128.2 68.5,52.81 68.18,53.13 v2(67.94,53.13)
MCSI0-USER: length 27.8
  Bottom Layer w0.102: v1(76.89,54.81) 77.04,54.81 77.29,54.56 80.04,54.56 84.89,49.71 84.89,42.22 85.98,41.12 93.95,41.12 94.11,40.96 FPC2.26
MICIN3N: length 20.9
  内层2 w0.127: v2(56.57,57.15) 56.57,57.55 56.66,57.64 56.66,57.91 57.47,58.73 62.18,58.73 64.72,61.27 65.99,61.27 v1(66.12,61.39)
  Bottom Layer w0.127: v1(66.12,61.39) 66.29,61.39 67.79,62.89 68.66,62.89 70.41,64.64 70.41,66.45 70.07,66.79 70.07,67.57 69.89,67.75 C241.1
MICIN3P: length 20.8
  内层2 w0.127: v1(66.12,60.76) 65.91,60.96 64.92,60.96 62.33,58.37 57.61,58.37 57.01,57.77 57.01,57.64 57.1,57.55 v2(57.1,57.22)